# EasyEDA Pro project sle_keyboard.eprj, board PCB1 (continued)
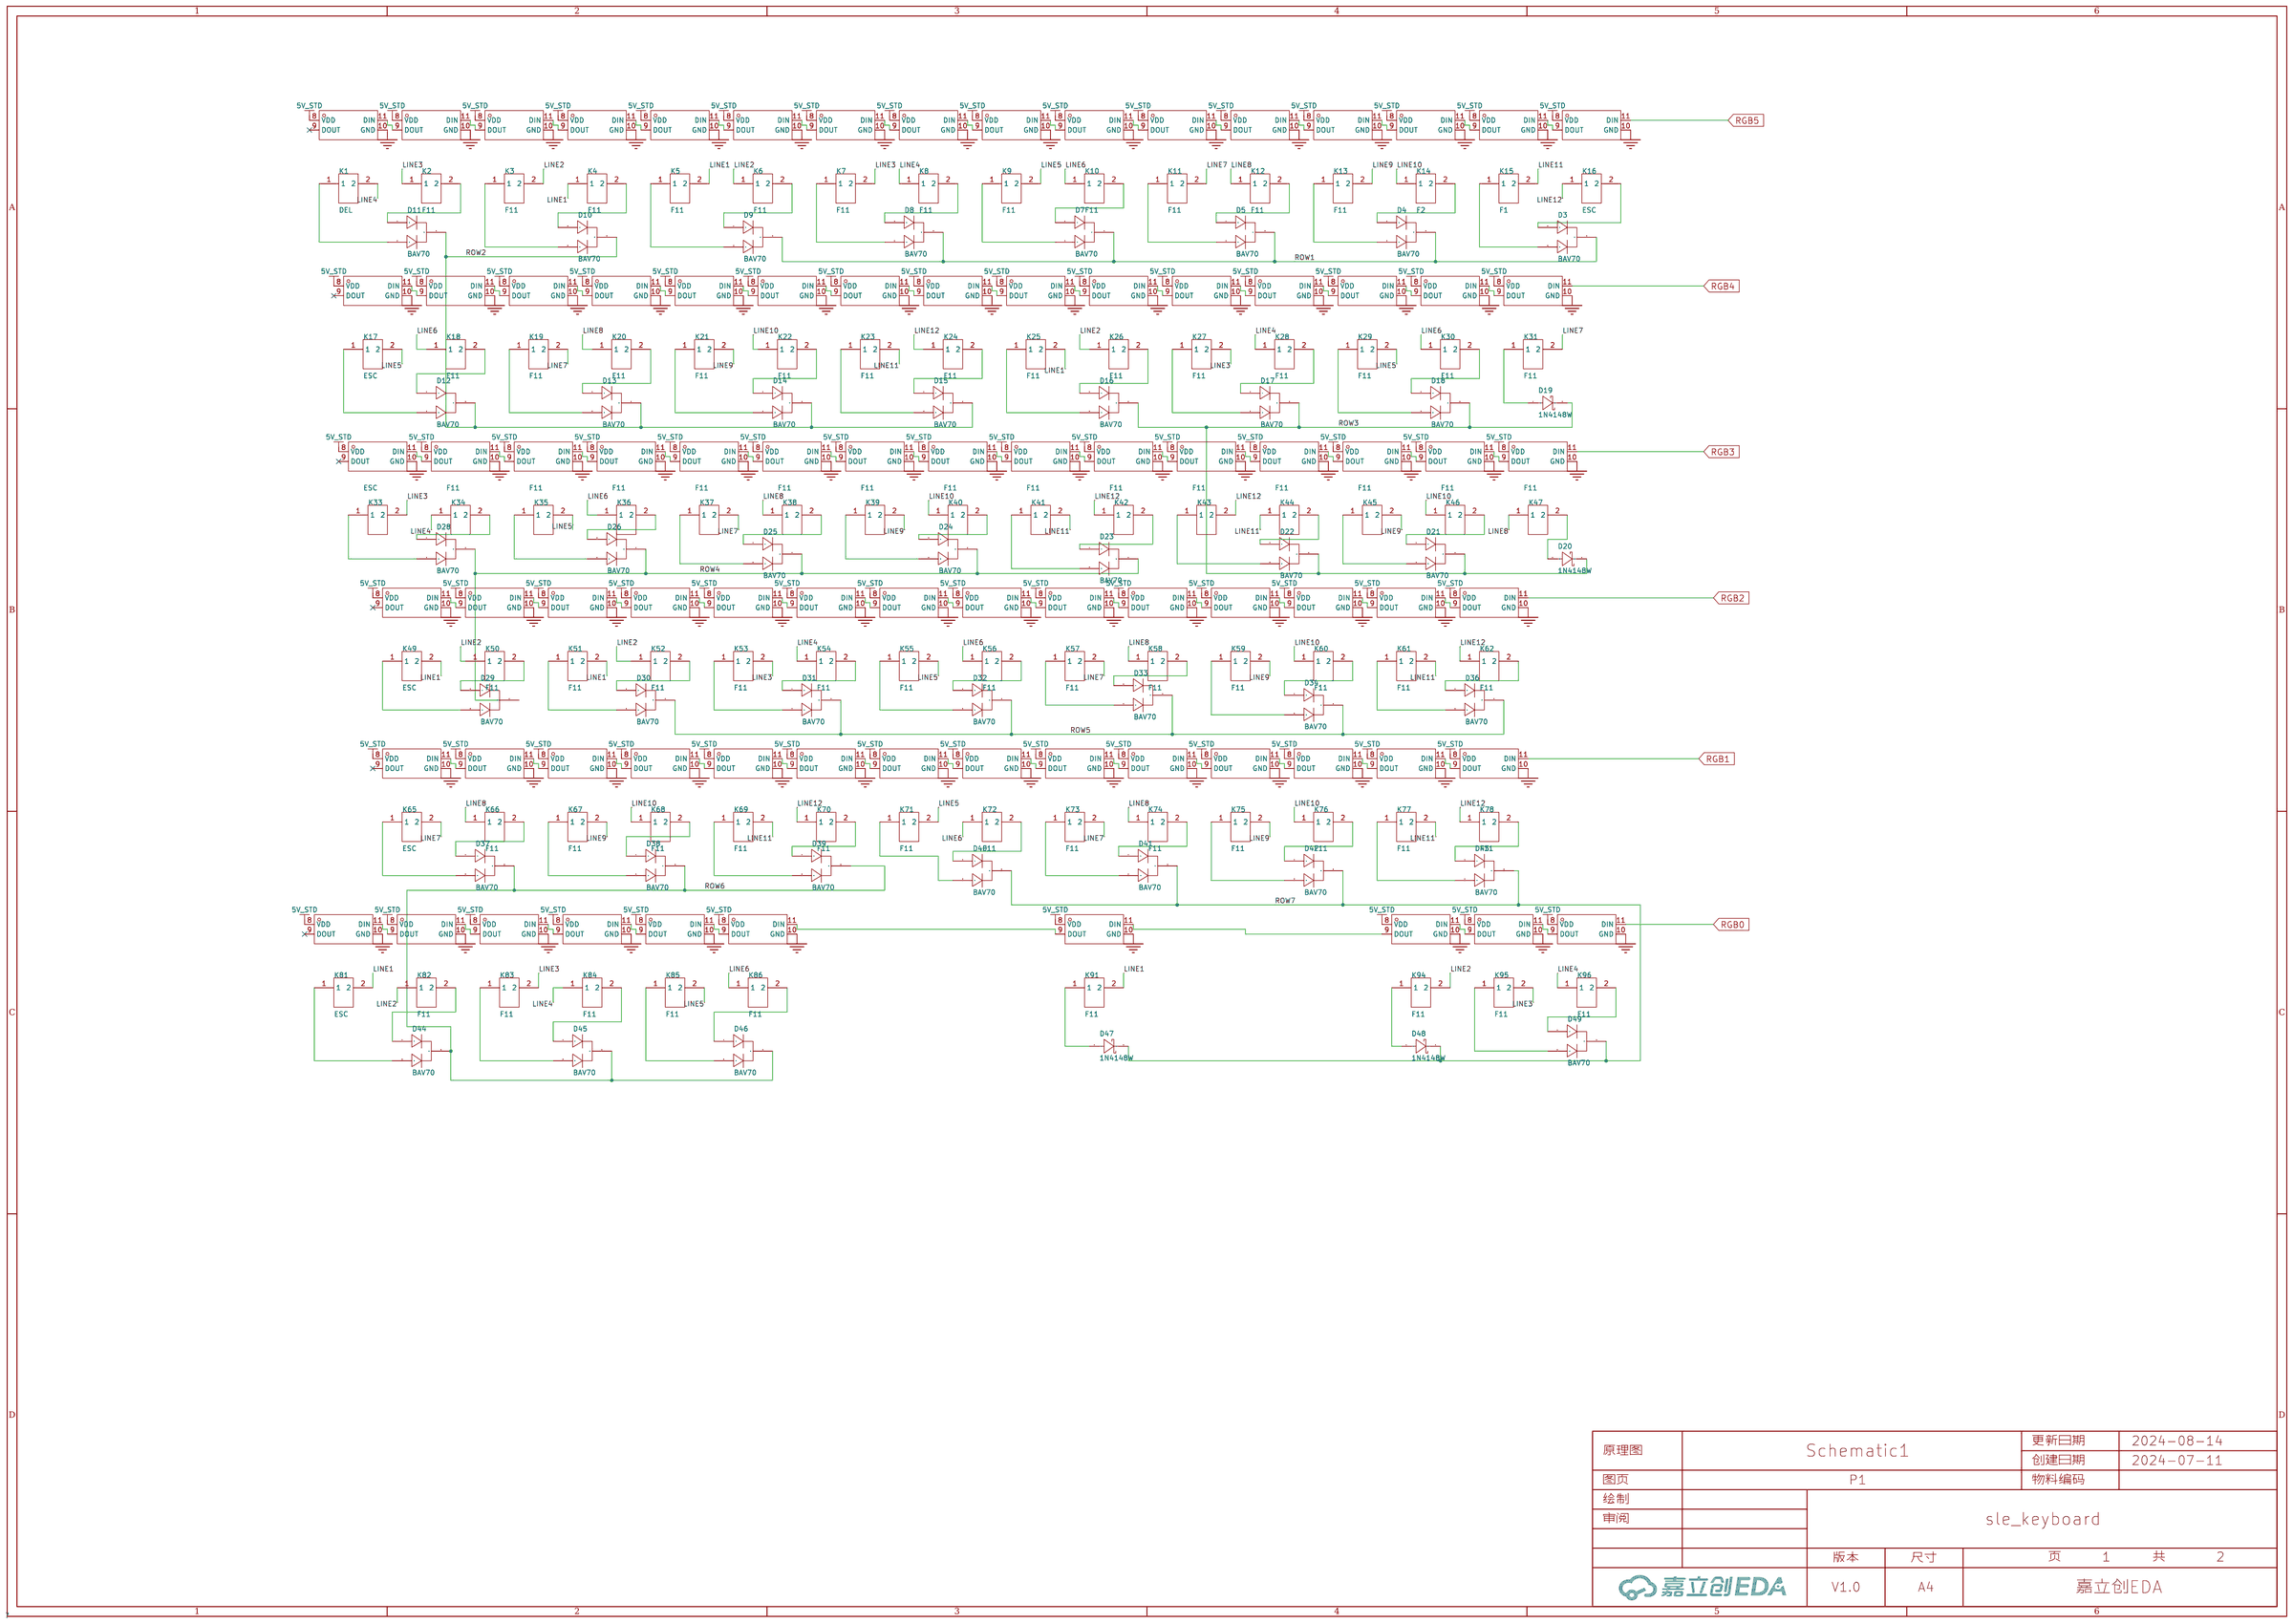
[diagram p0: P1]
## Routing (per net, layer and track width the routed paths; a pad name or vN(x,y) marks a point on that pad's centre or on a via; arc(x,y) is an arc through that point) (continued)
VBAT: length 75.4
  Top Layer w0.762: 80.77,93.35 80.76,93.34 CN1.1 ; C14.1 53.16,82.08 53.16,82.47
  Top Layer w0.889: 53.16,83.69 54.86,83.69 56.01,84.84 56.01,89.92 59.19,93.1 76.14,93.1 CN1.1
  Top Layer w1.016: 53.16,83.69 53.16,82.47 54.74,80.9 54.74,78.87 53.21,77.34 30.1,77.34 27.4,80.04 27.4,82.05 26.15,83.3 24.09,83.3
GPIO_09/NFC1: length 3.2
  Top Layer w0.178: U1.11 185.53,9 v1(185.29,8.76)
GPIO_10/NFC2: length 2.4
  Top Layer w0.178: 188.42,8.6 186.27,8.6 v1(186.06,8.38)
GPIO_21/NRST: length 1.1
  Top Layer w0.178: 193.72,7.7 193.72,6.94 v1(193.93,6.73)
LINE1: length 407
  Top Layer w0.178: 73.28,99.71 76.04,99.71 78.18,101.86 ; v1(78.57,99.37) 78.52,99.42 78.52,101.6 ; v1(64.35,47.66) 64.35,45.26 64.06,44.97 ; 173.41,82.92 173.41,85.38 v1(172.99,85.8) ; 1.89,44.7 1.89,41.51 v1(1.93,41.47) ; 64.34,44.97 45.98,44.97 43.66,47.29 43.66,48.81 42.42,50.05 30.27,50.05 23.63,43.4 17.93,43.4 16.64,44.69 9.38,44.69 7.39,42.71 3.04,42.71 2.14,43.61 2.14,44.92 ; 166.23,7.05 166.41,7.23 166.41,9.26 ; 1.97,9.2 2.32,8.85 2.32,6.86 ; 167.76,93.86 166.56,95.06 158.66,95.06 154.98,91.38 150.21,91.38 147.15,94.43 v1(83.57,94.43) ; v1(75.46,98.52) 73.96,98.52 73.35,99.12 ; 190.52,7.7 190.52,7.11 186.97,3.56 183.64,3.56 181.48,1.4 164.72,1.4 163.58,2.54 163.58,4.32 163.07,4.83 163.07,5.72 163.7,6.35 165.96,6.35 166.47,6.86
  Bottom Layer w0.178: v1(78.57,99.37) 78.63,99.37 v1(83.57,94.43) ; 64.31,47.69 64.31,53.72 69.6,59.02 69.6,71.53 75.46,77.39 v1(75.46,98.52) ; v1(1.97,9.25) 1.92,9.3 1.92,41.46 v1(1.93,41.47) ; v1(167.77,93.85) 172.47,89.15 172.47,86.31 v1(172.99,85.8) 172.99,77.27 175.81,74.44 175.81,69.62 174.23,68.04 174.23,65.51 171.29,62.57 171.29,50.55 169.93,49.19 169.93,46.23 166.89,43.19 166.89,9.68 v1(166.42,9.21)
LINE2: length 570.3
  Top Layer w0.178: v1(233.67,11.11) 233.63,11.11 ; 233.63,11.11 233.63,10.55 237.99,6.2 ; 233.63,11.11 213.17,11.11 210.19,14.1 v1(210.19,14.48) ; 233.63,11.11 233.63,11.13 ; 40.23,101.68 40.23,101.17 43.9,97.5 101.76,97.5 105.98,101.72 109.35,101.72 111.09,99.98 ; 37.49,7.34 37.59,7.24 37.59,6.5 35.06,3.97 34.77,3.97 ; 206.39,80.57 206.63,80.57 ; 206.63,80.57 217.42,80.57 221.1,76.89 227.91,76.89 ; 206.63,80.57 206.63,80.18 ; 206.63,80.57 206.63,81.92 205.43,83.12 ; v1(186.06,31.5) 186.82,30.73 v1(208.15,30.73) ; 46.51,42.41 v1(49.73,42.41) 52.51,39.63 95.12,39.63 96.86,41.37 96.86,42.03 ; v1(188.72,4.19) 188.62,4.3 188.62,4.73 190.92,7.03 190.92,7.7 ; v1(207.26,21.84) v1(210.19,21.84) ; 199.22,98.55 198.26,97.6 154.6,97.6 153.83,98.37 151.72,98.37 150.88,97.52 123.98,97.52 121.88,99.62 110.13,99.62
  Bottom Layer w0.178: v1(210.19,14.48) v1(210.19,21.84) 210.19,23.11 208.53,24.77 208.53,26.67 207.77,27.43 207.77,30.23 208.15,30.61 v1(208.15,30.73) ; v1(207.26,21.84) 206.12,20.7 206.12,17.67 203.06,14.61 196.09,14.61 195.83,14.35 195.83,10.29 190.25,4.7 190.25,4.57 189.87,4.19 v1(188.72,4.19) ; v1(205.44,83.17) 203.51,85.11 203.51,95.45 200.42,98.54 199.26,98.54 v1(199.25,98.55) ; v1(49.73,42.41) 44.41,37.09 44.41,17.89 37.6,11.07 v1(37.6,7.28) ; v1(186.06,31.5) 186.06,24.77 189.1,21.72 193.8,21.72 193.93,21.84 ; v1(43.18,98.23) 45.52,95.89 45.52,75.84 41.12,71.43 41.12,64.56 46.49,59.18 46.49,50.54 46.89,50.14 46.89,45.24 49.71,42.42 49.81,42.42 ; v1(233.67,11.11) 233.67,25.39 236.27,27.99 236.27,74.05 233.41,76.91 227.83,76.89 227.82,76.91
  vias: v1(227.91,76.89)
LINE3: length 685.5
  Top Layer w0.178: v1(38.31,99.38) 38.12,99.57 35.38,99.57 ; 40.27,7.16 40.21,7.22 40.21,9.85 42.41,12.05 v1(88.54,12.05) ; v1(189.83,106.98) 174.46,106.98 174.44,107.01 ; v1(176.66,10.16) 176.66,9.78 178.56,7.87 179.2,7.87 v1(180.97,6.1) ; 211.59,83.04 211.59,85.58 v1(211.66,85.64) ; v1(102.12,46.71) 102.09,46.68 102.09,44.65 ; 115.92,102.31 115.58,101.97 ; 115.58,101.97 115.14,101.53 v1(113.93,101.53) ; 115.58,101.97 110.27,107.28 97.33,107.28 97.3,107.32 ; v1(177.16,11.68) 178.05,12.57 v1(178.05,12.95) ; v1(92.1,107.34) 92.02,107.42 v1(60.71,107.42) ; 261.69,6.83 256.85,1.99 228.62,1.99 v1(225.22,5.4) ; 35.64,99.9 35.64,101.93 41.1,107.39 53.39,107.39 ; 35.43,74.49 35.45,74.49 34.99,74.03 23.7,74.03 18.54,68.88 4.25,68.88 2.84,67.47 2.84,64.27 ; v1(184.78,24) 184.4,23.62 184.4,21.72 183.9,21.21 175.39,21.21 v1(175.01,21.59) ; 211.71,79.5 210.19,79.5 v1(208.28,77.6) ; 191.32,7.7 191.32,7.04 189.61,5.33 v1(189.61,4.95) ; v1(168.29,107.1) 136.81,107.1 136.15,106.44 ; 193.44,87.9 206.38,87.9 211.69,82.59
  Bottom Layer w0.178: 38.31,99.43 31.12,92.23 31.12,81.16 35.45,76.82 v1(35.45,74.48) ; 225.19,5.39 222.6,7.99 222.6,30.28 214.7,38.18 214.7,47.22 218.04,50.56 218.04,72.79 211.66,79.18 v1(211.66,85.64) ; v1(174.46,107.02) 168.42,107.02 168.2,107.24 ; v1(189.61,4.95) 189.23,4.95 188.47,5.72 181.36,5.72 v1(180.97,6.1) ; v1(136.06,106.48) 131.45,101.87 123.11,101.87 121.37,100.13 115.2,100.13 113.93,101.4 ; v1(193.53,87.91) 189.81,91.63 189.81,106.97 ; v1(53.41,107.41) 60.7,107.41 60.71,107.4 ; 113.93,101.4 113.93,81.12 102.1,69.3 102.1,46.75 ; 113.93,101.4 113.87,101.45 ; v1(208.28,77.6) 205.87,77.6 202.82,74.55 202.82,67.95 199.52,64.64 193.04,64.64 191.26,62.87 191.26,62.61 188.47,59.82 188.47,46.48 188.09,46.1 187.96,46.1 186.44,44.58 185.93,44.58 185.18,43.83 185.18,24.4 v1(184.78,24) ; v1(177.16,11.68) 176.66,11.18 v1(176.66,10.16) ; v1(175.01,21.59) 174.37,21.59 173.61,20.83 173.61,19.43 178.05,14.99 v1(178.05,12.95) ; 88.54,11.99 88.54,12.79 103.02,27.27 103.02,45.8 v1(102.12,46.71) ; v1(97.29,107.34) v1(92.1,107.34)
  vias: v1(211.66,79.43)
LINE4: length 649.3
  Top Layer w0.178: 134.95,42.28 v1(134.95,40.41) ; v1(149.32,101.95) 149.32,100.37 148.89,99.94 ; 39.79,61.59 39.71,61.51 39.71,59.52 38.59,58.39 v1(7.08,58.39) ; v1(129.29,4.83) 129.41,4.95 136.65,4.95 138.43,3.18 154.43,3.18 ; 2.16,98.68 1.91,98.94 1.91,102.42 ; 61.95,57.13 43.87,57.13 39.85,61.15 ; 244.45,80.11 247.2,77.36 301.73,77.36 301.74,77.35 ; 244.45,80.11 244.43,80.13 ; 244.45,80.11 244.66,80.32 ; 244.45,80.11 238.06,73.72 149.06,73.72 v1(145.82,76.96) ; v1(301.76,77.38) 301.89,77.25 301.89,6.82 299.36,4.29 ; v1(190.88,4.45) 190.88,6.1 191.72,6.93 191.72,7.7 ; v1(174.24,2.54) 173.48,3.3 173.48,5.21 174.75,6.48 178.56,6.48 v1(178.94,6.1) ; 131.16,13.5 129.5,11.85 90.81,11.85 88.94,9.97 88.94,9.26 84.13,4.46 75.26,4.46 v1(73.1,6.62) 73.07,6.59 73.07,4.46
  Bottom Layer w0.178: v1(61.95,57.2) 61.95,14.73 64.34,12.34 72.85,12.34 73.65,11.54 73.65,7.21 73.14,6.7 ; v1(178.94,6.1) 178.94,5.33 181.03,3.25 182.96,3.25 183.13,3.43 189.87,3.43 v1(190.88,4.45) ; v1(134.95,40.41) 134.95,46.8 144.79,56.64 144.79,75.97 150.22,81.39 150.22,90.39 149.33,91.28 149.33,101.9 ; 134.92,40.31 134.92,38.15 131.19,34.43 v1(131.19,13.54) 131.19,6.73 v1(129.29,4.83) ; v1(2.2,98.63) 2.2,63.33 7.13,58.4 ; v1(154.44,3.18) 173.61,3.18 v1(174.24,2.54)
LINE5: length 501.2
  Top Layer w0.178: v1(247.35,82.96) 247.45,82.86 248.63,82.86 ; 140.11,45.84 140.28,46.01 v1(140.28,47.96) ; 240.47,94.13 240.24,94.36 v1(171.2,94.36) ; 154.14,102.07 154.14,100.3 155.02,99.42 ; v1(61.14,58.62) 53.64,58.62 49.65,62.61 49.65,63.69 ; 77.88,7.29 76.59,7.29 v1(75.99,7.9) ; 36.24,68.31 36.24,65.96 37.69,64.51 41.03,64.51 42.6,62.93 48.89,62.93 49.65,63.69 ; 49.65,63.69 49.23,64.11 ; v1(191.64,4.45) 191.64,6.22 192.12,6.7 192.12,7.7 ; v1(26.24,78.2) 26.22,78.18 6.43,78.18 2.36,82.25 ; v1(157.86,19.56) 136.19,19.56 v1(132.42,23.33) 130.34,25.41 130.34,25.92 ; v1(173.1,2.54) 170.7,4.94 164.48,4.94 v1(164.08,5.33)
  Bottom Layer w0.178: v1(36.29,68.25) 34.86,69.67 27.41,69.67 26.26,70.82 26.26,78.11 ; v1(240.5,94.14) 245.17,89.47 245.17,86.49 247.33,84.33 247.33,83.03 ; v1(157.86,19.56) 158.25,19.95 161.91,19.95 165.61,16.26 165.61,9.91 163.83,8.13 163.83,5.59 v1(164.08,5.33) ; v1(173.1,2.54) 173.74,1.91 179.96,1.91 180.85,1.02 188.98,1.02 191.64,3.68 v1(191.64,4.45) ; v1(132.42,23.33) 132.42,6.53 128.09,2.19 81.68,2.19 76.02,7.85 ; v1(140.28,47.96) 140.28,38 138.67,36.39 134.8,36.39 131.62,33.22 131.62,24.15 132.38,23.4 132.38,23.32 ; v1(75.99,7.9) 73.93,9.96 73.93,11.66 72.97,12.62 64.45,12.62 62.23,14.84 62.23,56.36 62.72,56.85 62.72,57.57 61.66,58.63 61.11,58.63 ; 171.31,94.25 170.47,95.09 159.32,95.09 v1(154.98,99.44) 154.98,85.2 145.29,75.51 145.29,56.58 140.67,51.96 140.67,48.31 140.29,47.93
LINE6: length 483.8
  Top Layer w0.178: 162.56,5.72 v1(162.43,5.72) 162.43,4.7 162.81,4.32 162.81,2.16 164.21,0.76 183.77,0.76 185.42,2.41 186.69,2.41 186.97,2.69 190.13,2.69 190.51,3.07 191.77,3.07 192.25,3.56 192.25,6.32 192.52,6.59 192.52,7.7 ; v1(47.61,80.04) 47.05,80.6 44.65,80.6 ; 82.13,74.58 81.19,75.52 v1(49.46,75.52) ; v1(107.83,40.82) 96.71,40.82 95.19,39.31 84.11,39.31 82.97,38.17 82.97,37.64 ; 82.85,61.46 82.85,58.84 ; 82.85,58.84 v1(82.6,58.59) ; 82.85,58.84 82.88,58.87 v1(82.88,64.13) ; 247.81,79.39 247.81,78.81 248.61,78.01 280.87,78.01 282.92,80.06 282.92,81.1 ; v1(173.02,44.8) 173.04,44.79 173.04,42.37 ; 111.24,4.12 113.03,5.9 v1(113.03,7.13) ; 163.1,23.38 168.47,23.38 v1(168.9,22.94) 166.87,20.9 153.71,20.9 153.06,21.56 ; 187.2,99.93 187.29,100.02 v1(187.29,101.74) ; 187.28,99.49 199.15,99.49 201.02,97.62 228.84,97.62 230.24,99.02 v1(235.33,99.02) ; v1(152.92,18.98) 152.71,19.2 112.42,19.2 111.38,20.24 111.33,20.24
  Bottom Layer w0.178: 173.02,44.73 173.02,37.45 168.74,33.17 168.74,23.12 168.94,22.92 ; 173.02,44.73 173.72,45.43 173.72,47.01 177.8,51.09 177.8,78.56 184.06,84.82 184.06,86.82 187.83,90.59 187.83,95.76 187.29,96.3 v1(187.29,101.74) ; 173.02,44.73 173.02,44.73 ; 173.02,44.73 v1(173.02,44.8) ; v1(152.92,18.98) 162.43,9.47 v1(162.43,5.72) ; 152.96,19.03 152.96,21.47 v1(153.05,21.57) ; 49.46,75.47 49.46,78.19 v1(47.61,80.04) ; v1(82.13,74.57) 82.78,73.92 82.78,64.22 82.88,64.12 ; 82.55,58.72 82.55,38.14 v1(82.98,37.72) ; 113.08,7.08 112.02,8.15 112.02,13.01 111.29,13.73 v1(111.29,20.29) 111.29,37.3 107.79,40.8 ; v1(247.72,79.38) 250.19,81.85 250.19,94.74 247.77,97.16 237.21,97.16 235.34,99.02
LINE7: length 520.7
  Top Layer w0.178: 2.59,25.6 2.12,26.07 2.12,29.79 3.34,31.01 12.94,31.01 ; 64.36,70.2 64.89,69.66 88.13,69.66 ; v1(87.43,70.46) 87.43,70.37 88.13,69.66 ; 168.84,25.78 168.84,28.97 v1(169.83,29.96) 169.85,29.98 173.25,29.98 174.56,31.29 178.06,31.29 179.34,30.01 179.34,27.9 180.02,27.22 v1(180.02,25.99) ; v1(206.94,20.17) 196.24,20.17 195.05,21.36 195.05,21.54 ; 192.73,101.62 192.64,101.71 192.64,106.05 194.07,107.48 v1(204.05,107.48) ; 178.42,45.49 178.64,45.72 v1(178.64,48.96) ; 88.13,69.66 178,69.66 v1(178.44,70.1) ; 213.22,106.71 213.87,107.36 v1(244.46,107.36) ; v1(268.28,106.68) 267.89,107.08 251.25,107.08 250.59,106.42 ; 59.24,82.9 59.32,82.82 v1(59.32,79.71) 55.83,76.22 18.18,76.22 v1(16.88,74.93) ; 284.96,87.08 284.96,86.05 287.91,83.1 ; v1(87.93,66.59) 87.81,66.47 87.81,64.29
  Top Layer w0.254: v1(196.47,8.26) 195.33,9.4 U1.27
  Bottom Layer w0.178: v1(250.57,106.4) 245.42,106.4 244.48,107.34 ; 59.32,79.71 59.32,75.24 v1(64.36,70.19) ; v1(192.64,104.7) 192.64,90.9 194.73,88.81 194.73,87.86 178.44,71.57 v1(178.44,70.1) 178.44,41.62 169.84,33.03 169.84,29.98 ; v1(87.43,70.46) 87.9,69.99 87.9,66.59 ; 16.91,74.92 16.91,52.99 12.78,48.85 12.78,46.3 14.18,44.9 14.18,32.33 v1(12.88,31.03) ; 204.07,107.49 204.81,106.76 v1(213.21,106.76) ; 207.12,20.28 206.96,20.12 206.96,18.1 202.82,13.97 202.22,13.97 202.22,13.97 199.39,13.97 199.26,13.84 197.87,13.84 196.47,12.45 v1(196.47,8.26) ; 268.2,106.68 268.26,106.62 268.26,100.79 273.65,95.39 279.33,95.39 284.94,89.78 v1(284.94,87.13) ; v1(194.94,21.46) 194.82,21.34 184.72,21.34 180.05,26
LINE8: length 457.1
  Top Layer w0.178: 120.83,61.23 124.11,57.95 210.1,57.95 ; 91.99,79.78 91.99,77.88 v1(92.07,77.8) ; 211.05,42.64 211.39,42.98 v1(211.39,45.42) ; v1(35.2,26.35) 35.2,23.47 34.95,23.22 ; 201.5,22.87 207.51,22.87 v1(207.9,22.48) ; v1(88.99,59.04) 86.6,56.65 34.95,56.65 33.1,54.81 ; 297.35,61.08 294.22,57.95 210.1,57.95 ; v1(225.41,102.1) 225.41,99.85 225.35,99.79 ; 88.96,58.97 89.81,58.12 118.28,58.12 120.04,59.88 120.04,60.95 ; v1(216.3,71.92) 221.27,71.92 221.86,72.5 ; v1(201.68,26.22) 201.68,24.24 201.75,24.17 ; 202.17,34.51 204.03,34.51 v1(206.29,36.76) ; 210.99,57.05 210.99,57.05 210.1,57.95 ; v1(35.57,40.21) 34.98,39.61 34.98,35.62
  Top Layer w0.254: U1.28 196.07,9.8 v1(197.36,8.51)
  Bottom Layer w0.178: 92.09,77.78 92.07,77.76 92.07,77.2 88.59,73.73 88.59,59.43 v1(88.99,59.04) ; 201.76,26.22 202.18,26.64 v1(202.18,34.56) ; 216.32,71.96 216.29,71.93 216.29,62.31 v1(211.02,57.03) 211.02,55.36 211.41,54.96 211.41,40.52 207.64,36.75 206.29,36.75 ; 35.62,40.23 33.13,42.71 v1(33.13,54.78) ; v1(221.84,72.48) 225.46,76.1 225.46,88.23 223.93,89.76 223.93,100.64 225.43,102.14 ; 201.34,13.46 197.99,13.46 197.36,12.83 v1(197.36,8.51) ; v1(34.97,35.65) 34.97,26.63 35.27,26.34 ; 201.34,13.46 201.36,13.5 202.74,13.5 207.9,18.65 207.9,22.25
LINE9: length 383.1
  Top Layer w0.178: 239.84,64.17 239.84,66.7 239.38,67.16 ; 216.61,44.75 216.61,48.03 217.47,48.9 220.21,48.9 220.38,49.06 ; v1(97.38,80.84) 97.38,82.94 97.45,83.02 ; 206.67,25.3 207.06,24.91 207.06,24.66 208.35,23.37 v1(208.91,23.37) ; 47.33,26.14 47.33,31.02 v1(47.26,31.09) ; v1(230.8,100.09) 230.76,100.13 230.76,101.52 ; 98.01,76.45 97.56,76.01 57.45,76.01 57.11,76.35 v1(57.11,76.44) ; 98.01,76.45 97.4,77.06 ; 98.01,76.45 v1(123.1,76.45) ; 221.01,58.57 127.66,58.57 125.99,60.24 125.99,63.72 126.05,63.78 ; 221.01,58.57 220.44,59.13 ; 221.01,58.57 236.94,58.57 239.91,61.54 239.91,63.48 ; 126.05,64.24 123.07,67.22 123.07,68.09 ; 206.82,25.56 206.82,28.63 205.72,29.73 ; v1(213.4,44.89) 213.42,44.87 215.88,44.87
  Top Layer w0.254: 194.62,10.2 196.81,10.2 v1(198.12,8.89)
  Bottom Layer w0.178: v1(198.12,8.89) 197.73,9.28 197.73,12.69 197.99,12.95 201.21,12.95 201.48,13.22 202.94,13.22 208.91,19.19 v1(208.91,23.37) ; 230.78,100.1 231.31,100.1 231.64,99.77 233.52,99.77 241.17,92.12 241.17,84.28 239.62,82.74 238.83,82.74 237.34,81.25 237.34,79.85 239.37,77.82 v1(239.37,67.19) ; v1(57.11,76.44) 50.24,69.57 50.24,61.88 50.52,61.6 50.52,39.72 49.96,39.15 49.96,33.79 47.27,31.11 ; v1(220.39,59.18) 220.38,59.16 v1(220.38,55.43) 219.31,54.36 219.31,51.27 220.42,50.17 v1(220.42,49.12) ; v1(205.73,29.72) 205.73,33.26 213.8,41.33 213.8,44.41 213.36,44.85 ; v1(97.4,77.06) 97.4,80.82 v1(97.38,80.84) ; 123.02,76.47 123.1,76.39 v1(123.1,68.12)
LINE10: length 400.2
  Top Layer w0.178: 130.33,79.87 130.33,76.76 v1(130.18,76.6) ; 240.07,23.52 241.64,25.09 241.64,25.76 ; U1.37 193.72,14.65 194.69,15.62 v1(194.69,15.88) ; v1(242.2,58.92) 271.34,58.92 273.31,60.9 ; v1(249.71,45.52) 249.71,43.06 249.19,42.54 ; 157.75,59.19 158.32,59.76 158.32,61.15 ; 157.75,59.19 218.87,59.19 219.58,59.89 221.32,59.89 222.07,59.14 236.02,59.14 237.69,60.8 237.69,61.48 237.67,61.49 ; 157.75,59.19 131.11,59.19 129.98,60.32 129.98,60.54 ; v1(266.72,99.53) 266.66,99.59 263.74,99.59 ; v1(232.79,21.34) 239.52,21.34 240.03,21.84 240.03,23.05 K76.1 ; v1(203.2,16.26) 232.16,16.26 v1(232.41,16) ; 272.97,62.08 274.75,63.85 274.75,64.17 ; v1(88.38,26.7) 87.53,25.86 87.53,24.23 ; v1(122.01,56.17) 85.55,56.17 84.21,54.83
  Bottom Layer w0.178: 242.19,58.92 239.61,61.49 v1(237.69,61.49) ; v1(232.41,16) 232.79,16.38 v1(232.79,21.34) ; 88.38,26.68 88.38,33.66 83.75,38.3 83.75,54.38 v1(84.19,54.83) ; 203.07,16.26 202.69,15.88 v1(194.69,15.88) ; 122.01,56.16 125.55,56.16 v1(129.95,60.57) 129.69,60.57 126.18,64.07 126.18,72.14 126.19,72.15 126.19,72.55 130.18,76.54 ; 249.69,45.56 249.69,51.43 v1(242.2,58.92) ; v1(241.65,25.76) 241.65,32.83 249.71,40.89 v1(249.71,45.52) ; v1(274.76,64.26) 274.76,77.03 272.56,79.22 270.35,79.22 269.15,80.42 269.15,97 266.65,99.51
LINE11: length 415.1
  Top Layer w0.178: 135.87,56.78 137.07,55.58 137.07,55.32 ; 135.87,56.78 124.1,56.78 122.25,54.93 97.21,54.93 96.23,53.94 ; 135.87,56.78 v1(164.06,56.78) ; 232.08,17.84 229.07,20.84 196.79,20.84 194.9,22.73 194.12,22.73 194.12,15.56 193.32,14.75 U1.38 ; 228.24,62.38 230.2,64.34 233.11,64.34 234.57,62.88 234.57,62.24 ; v1(254.55,47.56) 254.52,47.53 254.52,45.21 ; 245.07,25.92 244.32,26.67 240.67,26.67 240.09,26.1 235.35,26.1 v1(232.1,22.85) ; 135.41,83.22 135.41,79.8 v1(135.43,79.78) ; 268.89,102.02 266.73,102.02 266.13,101.42 ; 163.99,63.63 164.06,63.56 v1(164.06,61.84) ; v1(220.02,70.53) 217.67,70.53 216.66,69.53 184.16,69.53 183.39,68.76 ; 92.78,25.89 92.78,29.07 v1(92.56,29.29) ; v1(256.99,59.8) 256.55,59.35 242.87,59.35 241.67,60.55 241.67,61.47 241.68,61.49 ; v1(181.11,56.79) 164.1,56.79 164.08,56.81 ; v1(244.96,28.37) 245.14,28.19 245.14,26.1 ; 235.78,61.74 236.21,61.74 v1(237.49,63.02)
  Bottom Layer w0.178: 92.57,29.34 92.57,34.58 97.37,39.38 97.37,49.07 96.21,50.23 v1(96.21,53.87) ; 181.15,56.78 183.42,59.05 v1(183.42,68.83) ; 237.54,63.11 237.54,62.9 238.24,62.19 240.96,62.19 v1(241.68,61.48) ; v1(164.06,56.78) 164.06,61.83 v1(164.06,61.84) ; v1(266.13,101.45) 265.84,101.17 265.84,77.33 256.99,68.48 v1(256.99,59.8) 256.99,51.92 254.55,49.47 254.55,43.09 244.97,33.52 244.97,28.45 ; v1(232.1,17.85) v1(232.1,22.85) ; v1(228.17,62.33) 227.77,61.94 219.83,61.94 219.08,62.7 219.08,69.59 219.99,70.5 ; v1(137.06,55.26) 137.06,57.7 139.42,60.06 139.42,62.43 136.61,65.23 136.61,78.64 135.47,79.79
LINE12: length 375.5
  Top Layer w0.178: U1.39 192.92,14.86 193.8,15.74 193.8,19.06 192.83,20.03 192.83,22.19 ; 198.97,57.25 209.56,57.25 210.48,56.33 211.62,56.33 212.53,57.23 v1(297.47,57.23) ; 294.54,42.49 v1(296.95,42.49) ; 301.33,99.39 301.33,96.82 300.77,96.25 ; 168.24,80.1 168.3,80.05 v1(168.3,76.74) ; 139.59,55.95 165.43,55.95 165.5,56.01 197.72,56.01 v1(198.95,57.25) ; v1(292.82,23.4) 292.76,23.46 290.33,23.46 ; 125.24,24.04 126.32,25.13 v1(126.32,27.26) ; 197.09,61.43 198.8,61.43 v1(198.94,61.28) 200.89,63.23 201.4,63.23
  Bottom Layer w0.178: v1(165.53,55.97) 165.53,62.02 164.47,63.08 164.47,72.87 168.3,76.7 ; v1(192.79,22.35) 192.48,22.05 190,22.05 186.94,25.12 186.94,39.09 185.5,40.52 185.5,42.63 188.82,45.94 188.82,48.82 188.79,48.85 188.79,49.03 197,57.25 v1(198.95,57.25) 198.95,61.25 198.95,61.26 ; 292.81,23.38 292.81,25.47 296.98,29.64 296.98,44.12 297.44,44.58 297.44,71.36 295.09,73.71 295.09,81.84 297.88,84.63 297.88,93.38 v1(300.73,96.23) ; v1(139.72,55.94) 138.98,55.94 131.77,48.72 131.77,46.13 130.43,44.79 129.47,44.79 126.35,41.67 126.35,27.29
RF: length 3.1
  Top Layer w0.28: 194.62,10.6 197.74,10.6
RGB0: length 143.4
  Top Layer w0.178: 188.06,12.62 186.46,12.62 186.28,12.8 184.05,12.8 183.26,13.59 183.26,15.24 183.39,15.37 v1(183.39,15.62) ; v1(193.68,23.37) 193.6,23.29 190.3,23.29 190.12,23.11 188.72,23.11 v1(186.31,20.7) ; v1(211.46,22.1) 210.82,22.73 208.59,22.73 207.57,23.75 205.74,23.75 203.71,25.78 v1(202.82,25.78) ; K96.11 295.8,12.94 v1(296.54,12.19) ; v1(239.65,12.95) 239.34,12.95 236.22,16.08 236.22,16.26 235.2,17.27 231.39,17.27 231.01,17.65 v1(220.98,17.65)
  Bottom Layer w0.178: v1(193.68,23.37) 194.69,23.37 197.1,20.96 198.37,20.96 202.82,25.4 202.82,25.65 ; v1(296.54,12.19) 296.04,12.7 278.76,12.7 278,11.94 267.46,11.94 266.32,10.8 265.81,10.8 265.18,11.43 252.6,11.43 251.59,12.45 251.59,14.99 249.94,16.64 242.82,16.64 241.94,15.75 241.94,13.08 241.81,12.95 v1(239.65,12.95) ; v1(183.39,15.62) 185.8,18.03 185.8,20.19 v1(186.31,20.7) ; v1(220.98,17.65) 215.9,17.65 v1(211.46,22.1)
RGB1: length 144.6
  Top Layer w0.178: 286.33,32.97 286.38,32.92 288.49,32.92 289.09,33.53 289.09,37.2 287.94,38.35 v1(190.04,38.35) ; 188.36,12.19 186.32,12.19 186.14,12.37 183.97,12.37 183.68,12.66 183.05,12.66 182.5,13.21 182.5,16.51 182.75,16.76 183.26,16.76 183.68,17.18 183.68,18.52 185.01,19.85 186.96,19.85 189.72,22.61 190.22,22.61 190.4,22.79
  Bottom Layer w0.178: 189.96,38.25 187.99,36.28 187.99,25.63 190.5,23.12 v1(190.5,22.61)
RGB2: length 140.5
  Top Layer w0.178: U1.40 192.52,14.97 193.47,15.93 193.47,18.87 191.67,20.67 191.67,22.67 ; v1(197.65,52.05) 198.41,51.28 200.82,51.28 201.32,50.78 237.27,50.78 237.92,50.13 239.19,50.13 239.45,49.87 240.44,49.87 240.76,50.19 271.29,50.19 272.53,51.44 277.93,51.44 279.16,50.2 290.28,50.2 291.07,50.99 291.07,52.01
  Bottom Layer w0.178: v1(191.77,22.61) 194.92,25.76 197.18,25.76 198.28,26.85 198.28,51.4 197.61,52.07
RGB3: length 153.9
  Top Layer w0.178: 293.43,71.06 293.43,70.14 293.1,69.81 285.47,69.81 283.78,71.5 282.33,71.5 280.48,69.65 257.04,69.65 v1(256.71,69.98) ; 233.89,69.7 233.81,69.78 217.89,69.78 v1(217.5,69.39) ; U1.41 192.12,15.08 192.91,15.87 v1(192.91,16.98) ; 253.27,68.43 252.82,68.88 234.22,68.88 v1(233.83,68.48)
  Bottom Layer w0.178: v1(192.91,16.98) 194.53,16.98 195.2,17.65 202.3,17.65 202.55,17.4 204.6,17.4 205.52,18.32 205.52,20.87 207.36,22.71 207.36,33.61 214.21,40.46 214.21,56.4 217.48,59.67 217.48,69.37 ; 256.71,69.95 255.19,68.43 v1(253.29,68.43) ; v1(233.83,69.79) v1(233.83,68.48)
RGB4: length 182.5
  Top Layer w0.178: 298.35,89.83 298.79,89.39 v1(298.79,88.54) ; v1(202.12,16.89) 234.71,16.89 235.5,16.1 ; U1.42 191.72,15.31 192.27,15.87 v1(192.27,16.42) ; v1(238.47,19.77) 296.81,19.77 298.84,21.8
  Bottom Layer w0.178: v1(298.81,21.81) 298.81,77.57 300,78.75 300,82.04 298.29,83.75 298.29,88.06 298.78,88.55 ; 238.49,19.89 238.49,19.02 v1(235.55,16.08) ; v1(192.27,16.42) 201.61,16.42 202.15,16.95 202.28,16.95
RGB5: length 205.7
  Top Layer w0.178: 301.26,74.54 299.81,75.99 v1(272.78,75.99) ; 298.55,109.11 300.38,109.11 v1(300.78,108.71) ; v1(202.96,15.36) 235.8,15.36 239.21,11.95 243.18,11.95 243.78,12.55 252.99,12.55 ; v1(191.6,15.98) 191.32,15.7 U1.43
  Bottom Layer w0.178: 272.84,76.05 272.84,74.07 269.48,70.7 269.48,65 269.3,65 266.48,62.18 265.05,62.18 265.05,46.2 263.78,44.93 263.15,44.93 262.78,44.56 262.52,44.56 259.68,41.72 259.68,19.23 v1(253,12.55) ; v1(301.27,74.56) 302.5,75.8 302.5,107.01 300.82,108.69 ; v1(191.6,15.98) 192.35,15.24 197.1,15.24 197.28,15.42 202.96,15.42 202.98,15.43
ROW1: length 353.7
  Top Layer w0.178: 247.38,104.94 247.38,110.9 249.13,112.65 ; 211.17,112.65 249.13,112.65 ; 211.17,112.65 172.78,112.65 171.19,111.07 171.19,106.07 171.22,106.05 ; 211.17,112.65 208.87,110.35 208.87,106.48 208.98,106.38 ; 249.13,112.65 283.23,112.65 285.05,110.83 285.05,105.91 ; 94.8,105.33 94.8,110.2 97.06,112.46 135.56,112.46 ; 133.1,104.49 133.1,110 135.56,112.46 ; 135.56,112.46 135.74,112.64 172.75,112.64 ; 135.56,112.46 135.57,112.46 ; v1(175.88,47.7) 174.51,49.06 v1(174.15,49.06) ; 171.15,105.74 171.15,100.77 172.04,99.88 ; v1(172.21,22.33) 175.98,22.33 v1(176.05,22.4) ; U1.4 186.06,11.79 185.76,12.09 182.64,12.09 180.22,14.51
  Bottom Layer w0.178: 176.08,22.36 180.23,18.2 v1(180.23,14.51) ; 172.15,22.35 169.25,25.25 169.25,33.06 175.88,39.69 v1(175.88,47.7) ; 174.21,49.15 175.9,50.83 175.9,63.49 174.8,64.59 174.8,67.27 176.77,69.23 176.77,75.03 173.99,77.81 173.99,87.69 177.33,91.03 177.33,92.76 178.78,94.21 178.78,94.52 173.49,99.81 v1(172.09,99.81)
ROW2: length 306.4
  Top Layer w0.178: v1(167.74,39.69) 154.41,39.69 154.22,39.49 ; U1.5 186.02,11.4 185.6,11.81 181.27,11.81 179.49,13.59 v1(179.45,13.59) ; 57.45,106.36 57.45,109.09 54.16,112.39 19.64,112.39 18.15,110.9 18.15,106.2 18.18,106.18 ; 76.94,88.74 75.27,87.07 75.27,84.44 ; 57.39,105.79 57.39,99.76 58.4,98.76 65.02,98.76 68.84,102.59 74.11,102.59 ; v1(151.72,80.39) 151.72,85.97 151.74,85.98 ; v1(171.43,20.97) 174.48,20.97 v1(174.66,20.79) ; 112.84,88.85 113.64,88.05 113.64,84.88 113.78,84.74 ; 112.84,88.85 89.8,88.85 89.79,88.85 v1(77.02,88.85) ; 112.84,88.85 149.85,88.85 150.09,89.1 151.47,89.1 151.72,88.85 151.72,86.08 ; 18.1,105.96 18.1,98.62 15.75,96.27 15.75,94.42 17.85,92.31 17.85,84.41
  Bottom Layer w0.178: v1(179.45,13.59) 179.45,16.07 174.72,20.81 ; v1(74.09,102.6) 77.02,99.68 v1(77.02,88.85) ; v1(154.22,39.63) 154.22,57.87 152.49,59.59 152.49,62.66 155.31,65.48 155.31,76.83 151.75,80.4 ; 167.72,39.72 167.72,39.71 167.72,22.32 169.08,20.97 v1(171.43,20.97)
ROW3: length 323.4
  Top Layer w0.178: 300.71,69.23 300.68,69.2 284.69,69.2 283.22,70.67 ; v1(183.13,17.53) 181.99,17.53 178.69,14.22 178.69,13.21 180.47,11.43 185.47,11.43 185.91,11 U1.6 ; 255.95,69.19 281.76,69.19 283.17,70.61 ; 255.95,69.19 256.66,68.49 256.66,65.95 ; 255.95,69.19 218.46,69.19 218.06,68.8 218.06,65.91 ; v1(300.43,89.44) 302.09,91.09 302.37,91.09 ; 266.17,85.83 266.11,85.89 266.11,89.46 265.82,89.75 263.47,89.75 260.21,86.48 260.21,83.98 256.54,80.3 248.41,80.3 245.5,83.22 240.48,83.22 237.34,80.09 233.26,80.09 229.09,75.91 ; 229.12,75.8 229.12,74.68 v1(229.11,74.67) ; v1(190.37,81.41) 190.37,85.51 D16.3 ; 190.27,85.65 190.27,88.53 191.08,89.35 194.37,89.35 194.88,88.85 225.18,88.85 228.91,85.12 228.91,76.34 229.1,76.15
  Bottom Layer w0.178: v1(231.63,69.19) 231.63,73.2 230.16,74.67 v1(229.11,74.67) ; v1(190.37,81.41) 193.55,78.23 193.55,65.91 183.13,55.5 183.13,46.61 184.66,45.09 184.66,29.08 182.37,26.8 179.83,26.8 179.32,26.29 179.32,25.65 183.13,21.84 v1(183.13,17.53) ; v1(300.63,69.19) 300.66,69.22 300.66,82.42 298.65,84.43 298.65,86.66 300.43,88.45 v1(300.43,89.44)
ROW4: length 299.6
  Top Layer w0.178: v1(25.06,70.38) 25.06,70.38 ; 25.06,70.38 24.95,70.26 21.62,70.26 21.29,69.92 21.29,66.43 ; 25.06,70.38 26.11,69.33 42.27,69.33 43.48,70.54 50.98,70.54 52.16,69.36 66,69.36 ; 25.06,70.38 25.11,70.43 ; 103.79,69.36 66,69.36 ; 103.79,69.36 104.25,68.9 104.25,66.56 104.28,66.53 ; 103.79,69.36 140.75,69.36 ; 66,69.36 66.63,68.73 66.63,66.2 ; 188.42,10.6 185.77,10.6 185.29,11.08 176.5,11.08 175.13,12.45 168.78,12.45 v1(168.28,12.95) ; v1(170.56,63.75) 176.91,63.75 177.42,64.26 v1(179.07,64.26) ; 164.97,19.43 166.88,19.43 v1(167.89,18.42) ; 140.75,69.36 141.72,68.39 141.72,65.26 ; 140.75,69.36 179.17,69.36 180.21,68.33 180.21,65.91 180.25,65.87 ; 25.65,40.54 25.65,43.76 28.75,46.86 ; v1(180.59,64.39) 180.21,64.77 D23.3